# EasyEDA Pro project RCKid3.eprj, board RCKid (continued)
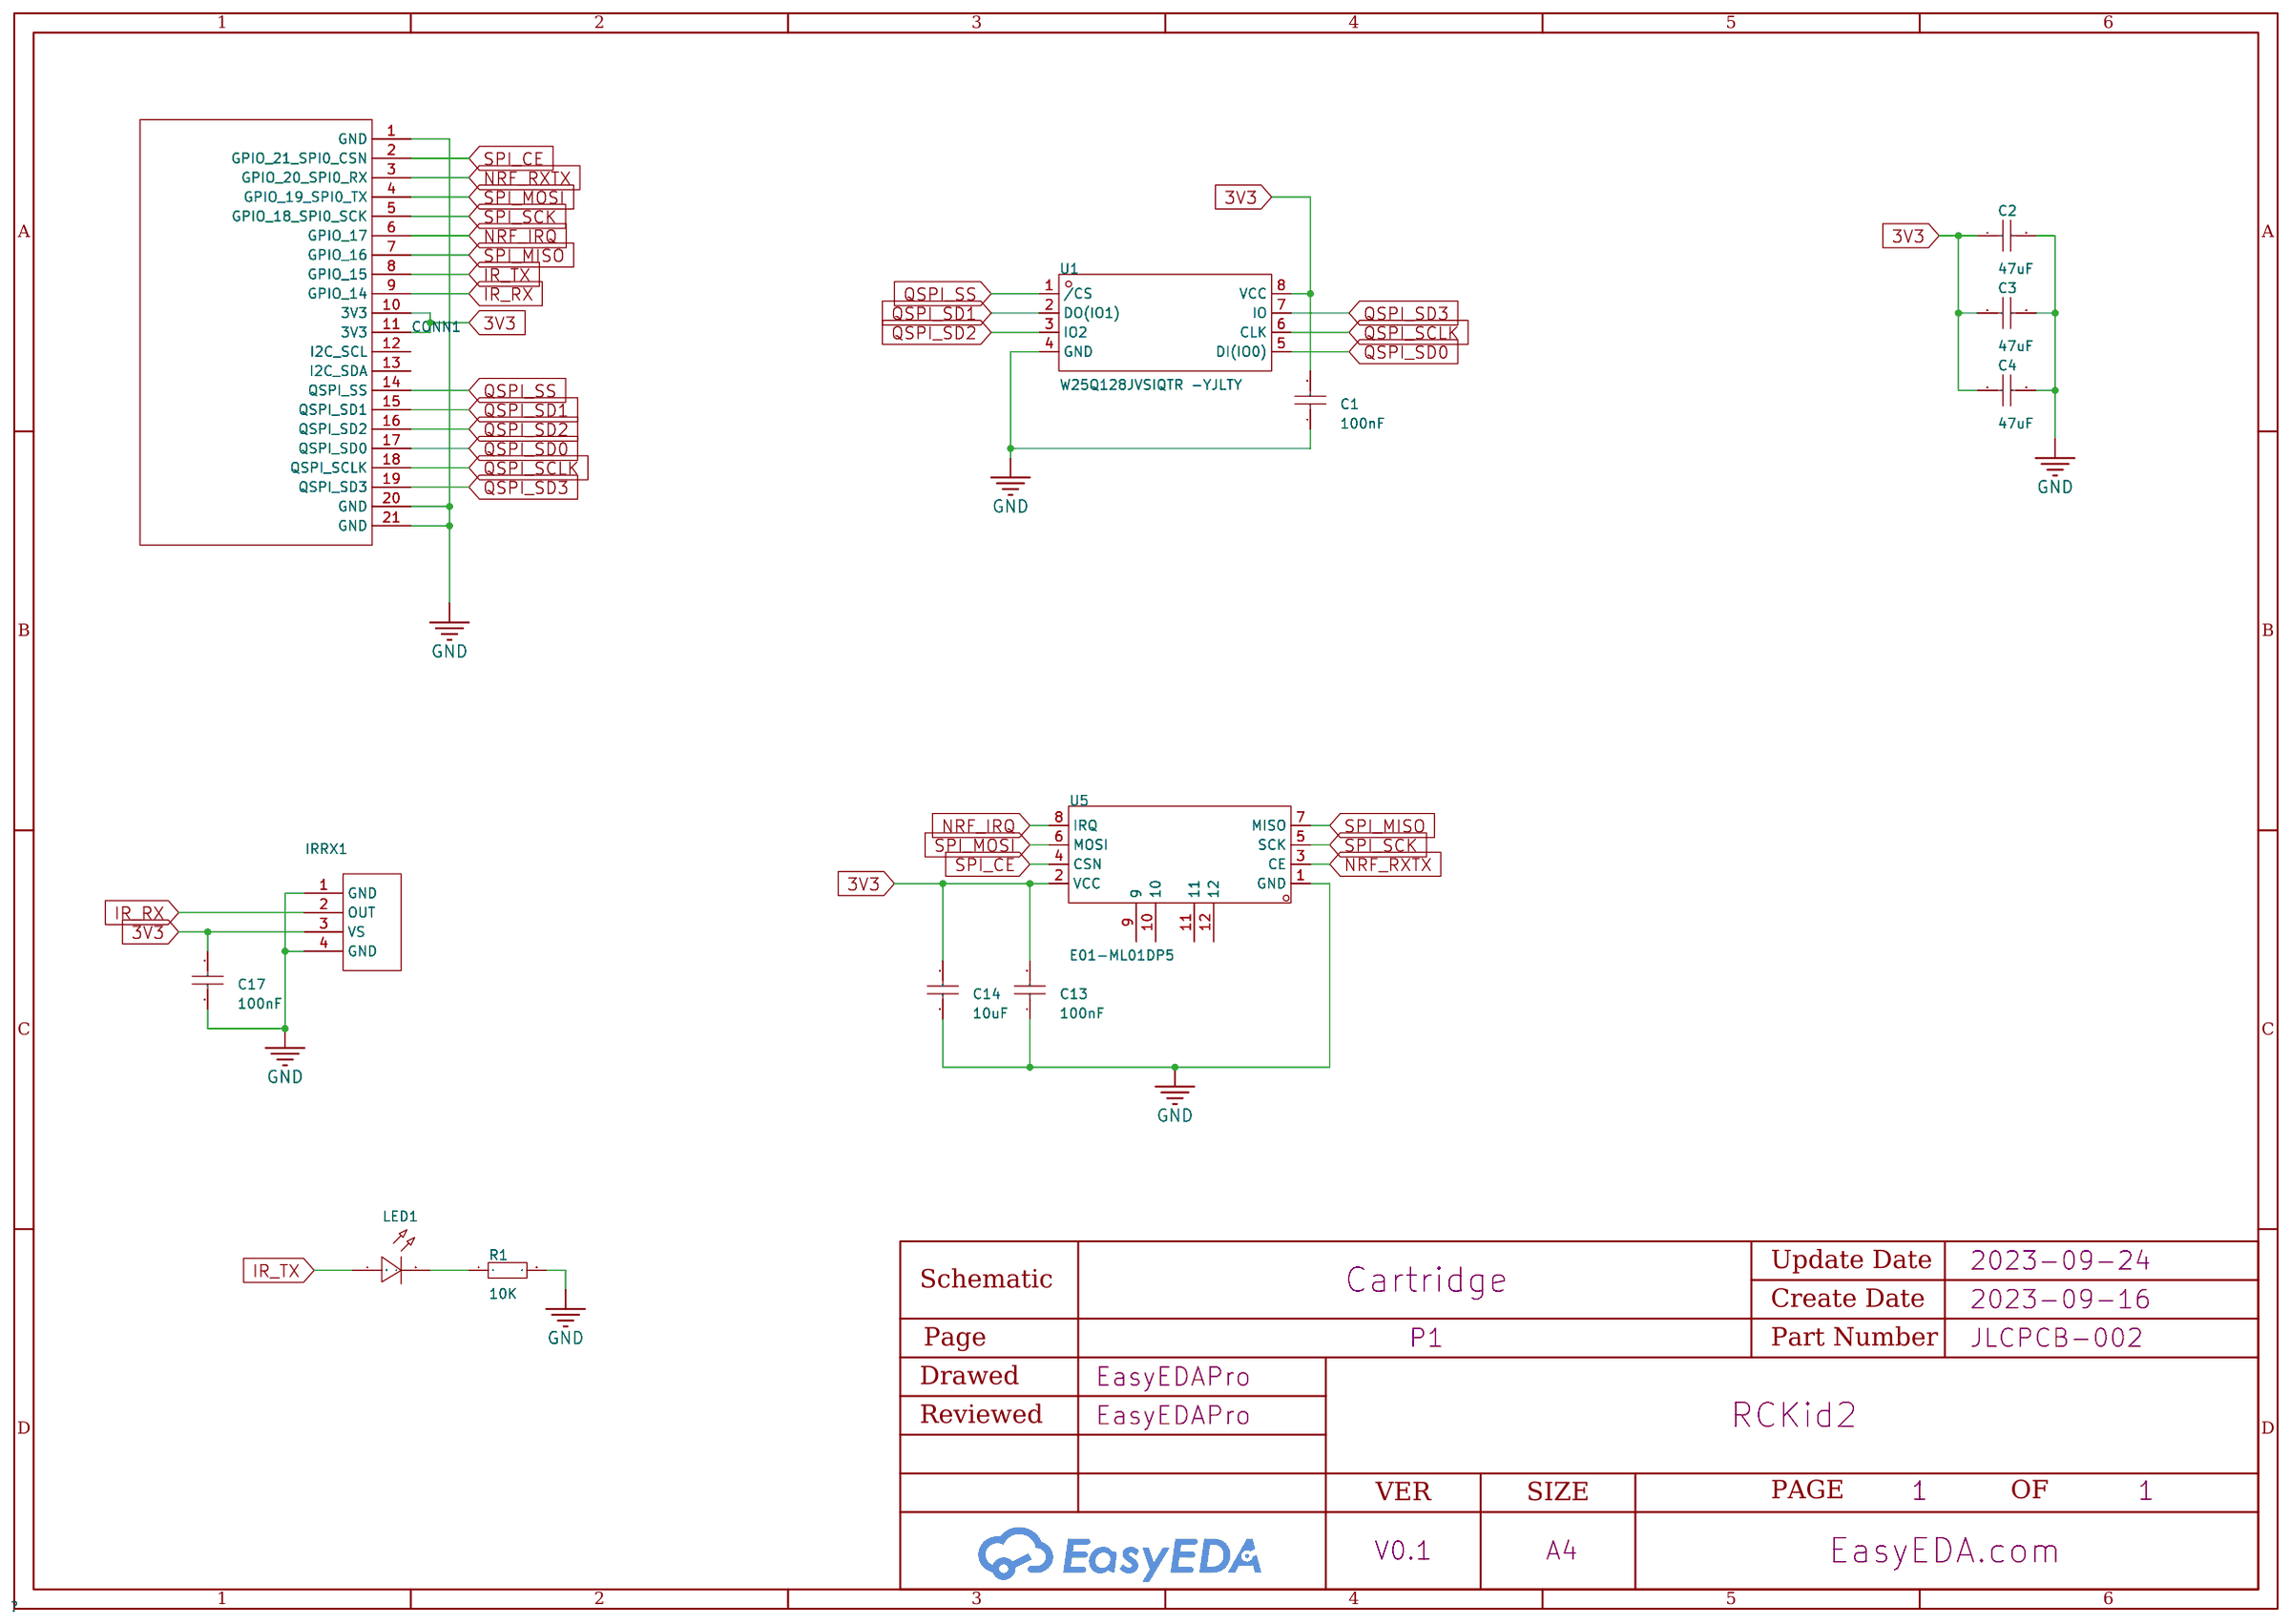
[diagram p0: NRF24L01P]
## Footprints (pads in the part's own frame, mm; a bottom-side part is the same pattern mirrored in y, then rotated) (continued)
SMT wire pad (2)
  rect 2.54x1.524 smd: 1(0,0)
  rrect 2.54x1.524 smd: 2(0,-2.54)
SOD-323_L1.8-W1.3-LS2.5-RD
  rect 1x0.75 smd: 1(-1.173,0) 2(1.173,0)
SOT-23-3_L2.9-W1.6-P1.90-LS2.8-BR
  rect 1.07x0.6 smd: 1(1.235,-0.95) 2(1.235,0.95) 3(-1.235,0)
SOT-23-6_L2.9-W1.6-P0.95-LS2.8-BR
  rect 1.1x0.6 smd: 1(1.35,-0.95) 2(1.35,0) 3(1.35,0.95) 4(-1.35,0.95) 5(-1.35,0) 6(-1.35,-0.95)
SOT-23_L2.9-W1.3-P1.90-LS2.4-BR
  rect 1x0.8 smd: 1(1.15,-0.95) 2(1.15,0.95) 3(-1.15,0)
TESTPOINT-SMD_BD1.5_P70-5000045R
  round 2 smd: 1(0,0)
TF-SMD_TF-01A
  rect 0.6x1.3 smd: 1(2.3,5.276) 2(1.2,5.276) 3(0.101,5.276) 4(-1,5.276) 5(-2.099,5.276) 6(-3.2,5.276) 7(-4.3,5.276) 8(-5.399,5.276) 9(-6.5,5.276)
  rect 1.2x1.4 smd: 10(-7.599,4.426) 13(7.08,4.426)
  rect 1.2x2 smd: 11(-7.76,-5.276) 12(7.76,-5.276)
UDFN-16_L3.3-W1.4-P0.40-BL-EP
  rect 0.2x0.4 smd: 1(-1.4,-0.6) 2(-1,-0.6) 3(-0.6,-0.6) 4(-0.2,-0.6) 5(0.2,-0.6) 6(0.6,-0.6) 7(1,-0.6) 8(1.4,-0.6) 9(1.4,0.6) 10(1,0.6) 11(0.6,0.6) 12(0.2,0.6) 13(-0.2,0.6) 14(-0.6,0.6) 15(-1,0.6) 16(-1.4,0.6)
  rect 2.8x0.4 smd: 17(0,0)
UQFN-10_L2.0-W1.5-P0.50-BL-EP
  rect 0.3x0.58 smd: 1(-0.748,-0.64) 4(0.752,-0.64) 6(0.752,0.64) 9(-0.748,0.64)
  rect 0.25x0.58 smd: 2(-0.248,-0.64) 3(0.252,-0.64) 7(0.252,0.64) 8(-0.248,0.64)
  rect 0.63x0.35 smd: 5(0.86,0) 10(-0.86,-0.002)
USB-C-SMD_TYPE-C-F02C-1BBWC1.6
  oval 1.2x2 hole 0.65x1.4: 13(5.62,1.425) 16(-5.62,1.425)
  oval 1.2x2.4 hole 0.65x1.8: 14(5.62,-2.575) 15(-5.62,-2.575)
  rect 0.3x1.1 smd: A5(-1.25,2.575) A6(-0.25,2.575) A7(0.25,2.575) A8(1.25,2.575) B5(1.75,2.575) B6(0.75,2.575) B7(-0.75,2.575) B8(-1.75,2.575)
  rect 0.6x1.1 smd: A9B4(2.4,2.575) A12B1(3.2,2.575) B9A4(-2.4,2.575) B12A1(-3.2,2.575)
VSON-6_L1.5-W1.5-P0.50-TL
  rect 0.6x0.25 smd: 1(-0.575,0.5) 2(-0.575,0) 3(-0.575,-0.5)
  rect 1x0.25 smd: 4(0.575,-0.5) 5(0.575,0) 6(0.575,0.5)
VSON-8_L3.0-W3.0-P0.65-TL-EP
  rect 0.85x0.34 smd: 1(-1.476,0.975) 2(-1.476,0.325) 3(-1.476,-0.325) 4(-1.476,-0.976) 5(1.476,-0.976) 6(1.476,-0.325) 7(1.476,0.325) 8(1.476,0.976)
  custom 1.52x3.42 smd: 9(0,-0.005)
WQFN-24_L4.0-W4.0-P0.50-TL-EP2.6
  rect 0.85x0.25 smd: 1(-2.025,1.25) 2(-2.025,0.75) 3(-2.025,0.25) 4(-2.025,-0.25) 5(-2.025,-0.75) 6(-2.025,-1.25) 13(2.025,-1.25) 14(2.025,-0.75) 15(2.025,-0.25) 16(2.025,0.25) 17(2.025,0.75) 18(2.025,1.25)
  rect 0.25x0.85 smd: 7(-1.25,-2.025) 8(-0.75,-2.025) 9(-0.25,-2.025) 10(0.25,-2.025) 11(0.75,-2.025) 12(1.25,-2.025) 19(1.25,2.025) 20(0.75,2.025) 21(0.25,2.025) 22(-0.25,2.025) 23(-0.75,2.025) 24(-1.25,2.025)
  rect 2.6x2.6 smd: 25(0.001,0)

## Nets
As in the schematic.

Pads without a net: 3V3 2; AMP 2; AUDIO 20 33; DISPLAY 1 2 3 4 8 25 26 27 28 34 35 36 37 38 39 40 41 42; HEADSET 5 6; L15 7 8 9 10; microSD 9 12 13; PWR 4 24; R88 2; RADIO 1 15 16 20 21; RP2350B 35 59; U26 4 10 11; U41 2 5; USB 13 14 15 16 A8 B8; VDD 2

## Via types
v1: diameter 0.5, hole 0.3, Top Layer to Bottom Layer, 660 vias

## Routing (per net, layer and track width the routed paths; a pad name or vN(x,y) marks a point on that pad's centre or on a via; arc(x,y) is an arc through that point)
3V3: length 31.2
  Top Layer w0.15: 28.9,28.39 28.9,29.59 29.2,29.59 v1(29.8,30.19) ; U26.12 27.9,39.69 28.9,38.69 U26.5 ; v1(31.7,41.79) 32.37,41.79 R124.2
  Top Layer w0.25: U40.8 22.79,52.94 ; C118.2 33.25,44.8 AVR.4 ; U26.5 30.85,38.69 C95.2 ; U41.1 29.85,53.84 29.2,53.19 28.74,53.19 C235.2 ; 29.55,41.99 29.55,41.44 29.05,40.94 U26.8
  Top Layer w0.3: U33.1 39.35,46.34 40.3,45.39 U33.5
  Top Layer w0.5: v1(33.5,43.69) 33.5,44.44 C118.2 ; v1(29.5,42.69) 29.5,42.05 29.55,41.99 ; R45.2 v1(26.4,45.39) ; C234.2 22.8,52.94 v1(22.8,52.19) ; C95.2 v1(30.9,37.79) ; R46.2 v1(26.4,44.09) ; v1(36.8,46.19) 37.6,46.19 37.75,46.34 U33.1 ; C235.2 v1(28.5,52.09)
  Bottom Layer w0.15: v1(29.8,30.19) 29.8,35.19 v1(29.4,35.59)
  vias: v1(29.4,36.39) v1(30.2,36.39) v1(30.2,35.59)
5V: length 20.1
  Top Layer w0.25: v1(46.05,45.14) 46,45.19 42.8,45.19 41.65,46.34 U33.6
  Top Layer w0.3: v1(41,23.49) 41,22.64 C144.2 41.05,22.5 LED12.2 ; LED8.2 56.1,51.94 C102.2 55.86,51.99 v1(55.1,51.99) ; LED11.2 23.11,26.24 C143.2 23.3,26.24 23.45,26.24 v1(24.4,25.29) ; v1(15.3,43.59) C104.2 14.45,43.39 LED10.2
  Top Layer w0.5: 36.3,22.59 v1(36.7,22.19) v1(35.9,22.19) 36.3,22.59 ; 36.3,22.59 C82.2 36.15,23.04 5V.1
  vias: v1(44.4,29.89)
5V_ON: length 30.8
  Top Layer w0.15: v1(33.2,24.89) 34.5,24.89 5V.3 ; v1(28.9,46.29) 28.9,45.82 R48.1 ; AVR.21 30.15,48.44 29.9,48.69 29.3,48.69 28.9,48.29 v1(28.9,48.09)
  Bottom Layer w0.15: v1(28.9,48.09) v1(28.9,46.29) 28.9,45.89 28.2,45.19 28.2,29.89 v1(33.2,24.89)
DVDD: length 10.3
  Top Layer w0.2: C115.2 v1(21.5,78.69) 21.3,78.69 21.2,78.79 RP2350B.10 ; RP2350B.51 7.3,78.79 v1(7,78.49) 6.6,78.09 C114.2 ; RP2350B.32 13.6,86.09 v1(13.4,86.29) 12.8,86.89 12.8,87.05
GND: length 81.5
  Top Layer w0.15: U40.3 26.45,53.44 v1(26.6,53.59) ; v1(1.9,19.39) 1.93,19.42 R113.2 ; v1(35.1,42.79) 34.53,42.79 34.5,42.82 ; 14.5,20.79 v1(14.5,20.09) 14.5,19.29
  Top Layer w0.2: 3.6,6.26 3.8,6.06 v1(3.8,5.39) ; 12.6,88.14 12.55,88.19 v1(12,88.19) ; v1(5,5.39) R57.2
  Top Layer w0.25: 65.4,24.59 v1(67,22.99) ; AUDIO.12 59.35,34.74 ; 59.35,34.74 59.85,34.24 AUDIO.28 ; 59.35,34.74 58.35,35.74 AUDIO.7 ; v1(17,91.09) 15.65,91.09 U39.4 ; v1(4,79.09) C110.1 ; v1(23.9,73.79) 23.85,73.79 23.74,73.9 23.74,73.95 C107.1 ; v1(12.1,90.39) 12.1,89.95 C154.2 ; C209.1 56.3,38.55 v1(56.3,39.29) ; v1(7.1,85.19) C111.1 ; v1(58.5,33.29) 57.85,32.64 AUDIO.17 ; 64.5,24.99 64.9,24.99 65.3,24.59 ; LED8.3 58.9,52.89 v1(58.9,53.79) ; 15.2,88.24 15.26,88.29 v1(16,88.29) ; v1(24.4,81.19) C112.1 ; v1(6.1,72.69) 6.1,73.55 ; RADIO.3 57.02,17.37 v1(56.8,17.59) ; C109.1 19.6,86.55 v1(19.6,87.29) ; C144.1 42.1,22.65 v1(42.1,23.49) ; v1(17.3,89.49) C153.2 ; C167.1 13.45,69.79 v1(14.2,69.79) ; v1(24.4,78.69) C115.1 ; v1(57.7,18.59) 58.02,18.91 58.02,19.5 ; AVR.25 32.75,47.94 AVR.3 ; v1(19.6,69.69) C108.1 ; 30.3,52.49 v1(30.3,51.89) ; v1(4,78.09) C114.1 ; U39.2 13.35,92.89 v1(12.2,92.89) ; LED12.3 42.1,19.59 v1(42.1,18.79)
  Top Layer w0.3: LED10.3 12.9,40.99 v1(12.9,40.09) ; v1(20.5,24.39) 20.5,25.29 LED11.3 ; C104.1 v1(12.1,43.59) ; C143.1 v1(23.2,24.39) ; 56,52.94 v1(56,53.79) ; v1(54.7,74.59) R55.2
  Top Layer w0.4: v1(66.7,35.39) 66.1,34.79 C204.2 ; v1(65.1,36.59) 64.14,36.59 C203.2 ; v1(8.7,9.59) 9.48,9.59 USB.B12A1 v1(9.5,10.59) ; C192.1 65.1,35.09 v1(65.4,35.39) ; v1(16.7,9.59) 16.67,9.56 USB.A12B1 v1(15.9,10.59) ; v1(58.9,28.09) 58.9,29.05 ; v1(54.9,25.29) R104.1
  Top Layer w0.5: v1(30.3,44.39) 29.5,44.39 ; 21.5,52.99 20.8,52.99 v1(20.79,53) ; v1(2.5,21.29) 2.5,20.59 ; v1(20.99,54) 21,53.99 21.7,53.99 ; v1(5.4,17.89) 5.4,18.79 ; v1(4.5,19.79) 5.1,20.39 5.2,20.39 ; 39.8,51.09 40.4,51.09 v1(40.9,51.59) ; v1(30.9,40.79) 30.9,39.89 ; 28.5,54.09 28.5,54.39 v1(29,54.89) ; 39.9,52.69 40.88,52.69 v1(40.89,52.7) ; 57.5,21.09 v1(57.5,21.79) 57.5,22.49 ; v1(47,8.49) 45.8,8.49 ; v1(26.4,50.59) 25.6,50.59 ; v1(37.3,45.39) 38.3,45.39 ; v1(8.6,27.79) 8.6,26.99 ; 8.6,26.99 v1(7.9,26.99) ; 8.6,26.99 8.6,26.79 ; v1(35.1,36.39) 35.8,36.39 ; v1(30.6,42.69) 30.6,42.09 ; 10.5,26.99 10.5,26.89 ; 10.5,26.99 v1(10.5,27.79) ; 10.5,26.99 v1(11.3,26.99) ; 10.5,26.99 10.4,26.99 ; v1(34.6,34.79) 34.6,35.49 ; v1(51.5,75.59) 51.5,74.78 Q6.2 51.58,74.79 v1(52.7,74.79) ; C118.1 34.6,44.45 v1(34.6,43.69) ; v1(34.9,37.39) 34.9,38.39 ; v1(8.1,16.99) 8.1,17.69 ; C81.1 v1(29.2,24.69) ; C132.1 50,89.09 v1(49,89.09)
  vias: v1(-31.5,49.69) v1(-31.5,48.59) v1(-31.4,44.99) v1(-31.3,43.29) v1(-31.1,46.79) v1(-30.55,54.38) v1(-30.4,62.49) v1(-29.8,42.39) v1(-29.6,45.59) v1(-29.5,77.89) v1(-29.5,75.89) v1(-29.5,73.89) v1(-29.2,48.29) v1(-29.1,50.19) v1(-29,43.79) v1(-28.9,60.99) v1(-28.7,45.99) v1(-28.6,39.99) v1(-28,74.59) v1(-28,61.89) v1(-27.7,48.49) v1(-27.2,44.69) v1(-27,62.59) v1(-26.8,49.89) v1(-26.5,46.59) v1(-26.3,58.79) v1(-26.3,43.49) v1(-26.2,48.29) v1(-26,73.49) v1(-26,31.99) v1(-25.2,44.49) v1(-24.6,42.79) v1(-24.4,58.99) v1(-24.4,56.19) v1(-24.4,47.99) v1(-24.4,36.19) v1(-24.4,33.79) v1(-24.2,74.59) v1(-24.2,54.09) v1(-24,45.79) v1(-23.8,49.69) v1(-23.7,32.59) v1(-23.6,40.19) v1(-23.2,47.59) v1(-22.2,42.89) v1(-22.2,39.29) v1(-22.1,37.49) v1(-21.9,77.49) v1(-21.9,71.99) v1(-21.9,69.99) v1(-21.9,67.99) v1(-21.9,65.99) v1(-21.9,64.19) v1(-21.8,47.29) v1(-21.7,74.59) v1(-21.6,44.99) v1(-21.6,41.59) v1(-21.1,34.69) v1(-20.5,44.29) v1(-20.3,83.89) v1(-20.3,47.89) v1(-19.9,65.99) v1(-19.9,64.19) v1(-19.9,36.99) v1(-19.7,45.69) v1(-19.5,71.99) v1(-19.1,74.59) v1(-19,77.59) v1(-18.2,38.89) v1(-17.9,78.39) v1(-17.8,76.59) v1(-17.7,51.59) v1(-17.5,41.79) v1(-17.2,38.89) v1(-17.1,46.19) v1(-17,47.89) v1(-16.9,64.19) v1(-16.7,77.29) v1(-16.6,74.59) v1(-16.2,58.19) v1(-16,61.09) v1(-16,46.19) v1(-15.8,43.59) v1(-15.6,52.09) v1(-15.3,77.29) v1(-15.3,53.69) v1(-15.3,49.59) v1(-14.8,47.79) v1(-14.3,74.59) v1(-14.3,40.69) v1(-14.1,51.39) v1(-14.1,46.49) v1(-14,61.09) v1(-13.9,44.09) v1(-13.8,77.59) v1(-13.4,57.49) v1(-13.3,73.59) v1(-13.3,52.49) v1(-13.1,40.09) v1(-12.8,55.69) v1(-12.8,43.19) v1(-12.7,76.99) v1(-12.7,45.59) v1(-12.3,64.19) v1(-12.3,49.99) v1(-12.1,74.99) v1(-11.9,59.99) v1(-11.8,57.09) v1(-11.8,41.89) v1(-11.6,76.19) v1(-11.6,43.89) v1(-11.5,47.09) v1(-11.4,53.49) v1(-11.4,49.19) v1(-11.1,40.59) v1(-10.8,42.69) v1(-10.6,81.79) v1(-10.5,40.19) v1(-10.4,43.79) v1(-10.3,52.59) v1(-10,50.59) v1(-9.9,94.89) v1(-9.8,47.59) v1(-9.6,88.19) v1(-9.6,83.79) v1(-9.4,45.29) v1(-9.3,46.49) v1(-9.1,38.69) v1(-8.9,41.59) v1(-8.8,48.99) v1(-8.7,88.09) v1(-8.6,44.39) v1(-8.5,51.49) v1(-8.1,96.79) v1(-8.1,47.29) v1(-7.5,86.39) v1(-7,90.79) v1(-7,40.49) v1(-6.4,51.19) v1(-6.2,45.79) v1(-5.3,46.29) v1(-4.8,93.39) v1(0.9,107.89) v1(1,103.19) v1(2.2,103.99) v1(3,103.69) v1(4.2,109.89) v1(4.2,103.99) v1(5.3,103.89) v1(6.2,103.99) v1(6.9,69.79) v1(7.5,107.09) v1(8.2,103.99) v1(9.8,22.39) v1(9.8,20.79) v1(9.8,13.59) v1(10.2,103.99) v1(10.4,109.99) v1(11.5,20.79) v1(11.6,22.39) v1(12.2,103.99) v1(12.8,80.39) v1(12.8,78.99) v1(12.8,77.59) v1(13.4,109.99) v1(14.1,53.49) v1(14.2,103.99) v1(14.2,80.39) v1(14.2,78.99) v1(14.2,77.59) v1(14.5,15.39) v1(15.5,24.89) v1(15.6,80.39) v1(15.6,78.99) v1(15.6,77.59) v1(16.2,103.99) v1(16.2,49.99) v1(18.1,109.99) v1(18.2,103.99) v1(20.2,103.99) v1(20.4,107.89) v1(20.4,105.49) v1(22.1,109.99) v1(26.2,109.99) v1(26.2,103.59) v1(27.2,6.49) v1(27.7,2.49) v1(28.6,-2.01) v1(28.8,-0.01) v1(29.2,31.89) v1(29.8,6.99) v1(30.1,-4.31) v1(30.3,31.89) v1(31,4.79) v1(31.2,1.09) v1(31.3,8.29) v1(31.5,109.99) v1(31.9,8.19) v1(32.2,48.99) v1(32.2,47.39) v1(32.8,8.49) v1(33.5,1.49) v1(33.6,23.99) v1(33.7,9.19) v1(33.8,48.99) v1(33.8,47.39) v1(34.4,103.39) v1(34.5,8.89) v1(34.5,1.79) v1(34.6,6.29) v1(34.8,10.19) v1(34.9,109.99) v1(35.2,-0.61) v1(35.7,10.69) v1(35.8,6.69) v1(35.9,10.79) v1(35.9,8.09) v1(36,7.89) v1(36.1,9.49) v1(36.1,4.69) v1(36.2,25.69) v1(36.8,9.49) v1(37.1,10.89) v1(37.4,5.89) v1(37.5,9.29) v1(38.4,109.99) v1(38.4,11.49) v1(38.9,103.59) v1(39,7.99) v1(39.1,92.19) v1(39.7,10.29) v1(39.9,12.79) v1(40,11.79) v1(40.7,39.99) v1(40.7,39.19) v1(40.9,13.49) v1(41,103.19) v1(41,9.89) v1(41.2,11.59) v1(41.4,109.99) v1(41.6,8.79) v1(41.9,12.79) v1(42.1,13.79) v1(42.1,6.59) v1(42.4,103.59) v1(42.5,10.69) v1(42.5,9.89) v1(42.6,11.79) v1(43,42.59) v1(43.5,6.29) v1(43.7,103.49) v1(44.4,109.99) v1(44.4,30.89) v1(45.2,103.09) v1(45.7,103.69) v1(46.6,103.19) v1(47.3,109.99) v1(47.5,103.19) v1(48.7,103.39) v1(48.8,30.79) v1(49.2,109.99) v1(50.2,103.99) v1(50.2,99.99) v1(50.2,95.99) v1(51.2,109.99) v1(51.4,106.49) v1(54.2,103.99) v1(54.2,95.99) v1(54.2,91.99) v1(54.2,87.99) v1(55,23.09) v1(55.3,107.29) v1(55.8,103.69) v1(56,25.69) v1(56.8,18.59) v1(57.2,109.99) v1(57.7,17.59) v1(58.2,103.99) v1(58.2,99.99) v1(58.2,95.99) v1(58.2,91.99) v1(58.2,87.99) v1(58.5,35.69) v1(58.9,25.69) v1(59.4,15.89) v1(59.8,25.39) v1(60.5,103.89) v1(60.8,105.19) v1(60.8,35.79) v1(60.85,33.24) v1(61.5,109.99) v1(62.2,103.99) v1(62.2,95.99) v1(62.2,91.99) v1(62.2,87.99) v1(63.2,5.09) v1(63.6,106.19) v1(63.6,103.99) v1(64.6,109.79) v1(65.1,65.09) v1(66.2,103.99) v1(66.2,99.99) v1(66.2,97.99) v1(66.2,95.99) v1(66.2,93.99) v1(66.2,91.99) v1(66.2,89.99) v1(66.2,87.99) v1(66.2,85.99) v1(66.2,83.99) v1(66.2,81.99) v1(66.2,79.99) v1(66.2,77.99) v1(66.2,75.69) v1(66.2,72.99) v1(66.2,70.09) v1(66.7,65.09) v1(66.7,31.29) v1(67.5,107.89) v1(67.5,105.29) v1(67.6,67.79) v1(67.6,26.39) v1(69.8,42.49) v1(76.3,73.69) v1(77.1,75.09) v1(78.7,73.69) v1(79.2,92.59) v1(79.2,88.89) v1(79.2,84.79) v1(80.2,82.29) v1(80.7,83.99) v1(81.2,90.49) v1(81.3,73.69) v1(81.5,85.39) v1(81.6,72.29) v1(82.2,86.79) v1(82.5,78.29) v1(82.6,93.19) v1(82.62,72.24) v1(82.7,82.49) v1(82.7,75.79) v1(82.9,72.89) v1(83,89.39) v1(83.2,80.39) v1(83.6,76.29) v1(83.6,71.39) v1(83.8,84.59) v1(83.9,73.69) v1(84,90.49) v1(84.9,88.09) v1(85.5,86.19) v1(85.5,80.49) v1(85.7,91.39) v1(85.7,75.09) v1(85.9,79.89) v1(85.9,77.19) v1(86.1,93.69) v1(86.4,82.89) v1(86.4,74.29) v1(86.6,89.69) v1(86.8,84.49) v1(87.5,78.19) v1(87.6,79.79) v1(87.7,73.69) v1(87.8,87.19) v1(88.1,75.39) v1(88.2,85.29) v1(88.7,93.79) v1(88.8,80.99) v1(88.8,72.09) v1(88.9,89.99) v1(89.3,83.59) v1(89.4,77.19) v1(90.2,80.29) v1(90.3,73.69) v1(90.6,85.69) v1(90.8,88.29) v1(91.3,91.69) v1(91.3,77.89) v1(91.5,74.59) v1(91.6,82.79) v1(93.2,72.89) v1(95,73.69)
VBATT: length 4
  Bottom Layer w0.15: v1(17,16.49) R126.2
  Bottom Layer w0.5: v1(17,16.49) v1(17,14.49)
VCC: length 10.7
  Top Layer w0.15: 26.7,32.49 26.7,31.39
  Top Layer w0.5: v1(32.8,23.99) 5V.5 30.8,23.99 C81.2
  Top Layer w0.7: C220.2 C219.2 6.45,25.39 L17.2 6.1,27.96 AAA_PWR.2
  vias: v1(11.5,25.59) v1(11.5,24.79) v1(12.3,25.59) v1(12.3,24.79) v1(13.1,25.59) v1(13.1,24.79) v1(23.4,32.99) v1(23.4,32.29) v1(24.1,32.99) v1(24.1,32.29) v1(33.4,39.89) v1(33.4,39.19) v1(34.1,39.89) v1(34.1,39.19)
VDD_EN: length 28.1
  Top Layer w0.15: v1(34.8,45.29) 33.9,45.29 33.75,45.44 AVR.5 ; v1(30.6,50.49) 27.6,50.49 v1(26.4,51.69) 25.84,52.25 U40.1 ; 36.7,38.19 36.2,38.19 36,38.39 v1(36,38.59) ; v1(26,54.99) 25.7,54.99 25.2,54.49 U40.5
  Bottom Layer w0.15: v1(26.4,51.69) 26,52.09 v1(26,54.99) ; v1(30.6,50.49) 31.5,50.49 34.8,47.19 v1(34.8,45.29) 34.8,44.29 36,43.09 v1(36,38.59)
ACCEL_INT: length 9.4
  Top Layer w0.15: v1(29.6,48.09) 29.9,48.09 30.05,47.94 AVR.22 ; v1(28.8,41.69) 28.55,41.44 U26.9
  Bottom Layer w0.15: v1(28.8,41.69) 28.8,44.79 29.6,45.59 v1(29.6,48.09)
AUDIO_INT: length 67.5
  Top Layer w0.15: RP2350B.2 19.5,75.59 20,75.09 20,74.79 23.1,71.69 23.1,69.29 30,62.39 30,58.59 31.5,57.09 34.3,57.09 34.7,56.69 47.7,56.69 50.9,53.49 50.9,41.99 52.9,39.99 52.9,36.29 53.95,35.24 AUDIO.11
AUDIO_MICBIAS: length 7
  Top Layer w0.15: R123.2 v1(54.9,30.89) R103.2 ; AUDIO.19 58.85,31.44 v1(59.1,31.19)
  Bottom Layer w0.15: v1(54.9,30.89) 58.8,30.89 v1(59.1,31.19)
AUDIO_RESET: length 74.8
  Top Layer w0.15: AUDIO.31 62.55,35.74 62.8,35.99 62.8,40.59 60.5,42.89 54.5,42.89 53.9,43.49 53.9,55.09 49.3,59.69 36.2,59.69 35.61,60.29 35.61,61.89 33.8,63.69 33.15,63.69 26.1,70.74 26.1,74.79 23.5,77.39 21.4,77.39 20.8,77.99 RP2350B.8
AVR_INT: length 33.7
  Top Layer w0.15: v1(21.8,71.19) 18.91,74.08 RP2350B.80 ; v1(26.4,49.19) 28.1,49.19 28.2,49.29 30,49.29 30.35,48.94 AVR.20
  Bottom Layer w0.15: v1(26.4,49.19) 23.6,51.99 23.6,56.24 22.7,57.14 22.7,70.29 v1(21.8,71.19)
AVR_TX: length 36.5
  Top Layer w0.15: AVR.24 24.45,46.94 14.3,57.09 v1(12.8,57.09)
  Bottom Layer w0.15: DEBUG.1 8.02,57.09 v1(12.8,57.09)
BTN_1: length 45
  Top Layer w0.15: D17.2 D9.2 43.23,51.19 41.8,51.19 v1(40.5,49.89) 40.05,49.44 35.02,49.44
  Top Layer w0.2: v1(35.9,19.59) 35,18.69 D5.2
  Bottom Layer w0.15: v1(35.9,19.59) 37.9,21.59 37.9,47.29 40.6,49.99
BTN_2: length 46.4
  Top Layer w0.15: D10.2 D14.2 43.28,47.94 35.02,47.94
  Top Layer w0.2: D6.2 33.3,18.79 33.5,18.99 v1(34.2,18.99)
  Bottom Layer w0.15: v1(34.2,18.99) 37.6,18.99 39.1,20.49 39.1,45.49 41.6,47.99 v1(42.3,47.99)
BTN_3: length 48.2
  Top Layer w0.15: D11.2 36.7,17.89 35.8,16.99 32.5,16.99 31.6,17.89 D7.2 ; 35.02,48.44 41.15,48.44 v1(41.9,49.19) 42.3,49.59 D15.2
  Top Layer w0.2: 36.7,18.22 38,19.52 v1(38,20.49)
  Bottom Layer w0.15: v1(38,20.49) 38.5,20.99 38.5,45.79 v1(41.9,49.19)
BTN_4: length 38.8
  Top Layer w0.15: AVR.6 34.83,46.17 v1(36.9,44.09)
  Top Layer w0.2: D12.2 28.2,18.89 28.5,19.19 v1(29,19.19) 29.6,19.19 29.9,18.89 D8.2
  Bottom Layer w0.15: v1(29,19.19) 29.7,19.89 35.3,19.89 37.3,21.89 37.3,43.69 v1(36.9,44.09)
BTN_ABXY: length 102.7
  Top Layer w0.15: v1(40.5,33.49) A1.2 A1.4 ; 44.1,18.09 B2.2 39.7,17.99 v1(39,18.69) 36.7,16.39 25.75,16.39 24.2,17.94 B3.4 ; 35.02,47.44 41.95,47.44 v1(42.3,47.09) ; v1(55.2,45.59) B1.2 B1.4
  Top Layer w0.2: B3.4 B3.2 ; B2.4 B2.2
  Bottom Layer w0.15: v1(55.2,45.59) 53.7,47.09 v1(42.3,47.09) 41.6,47.09 39.7,45.19 39.7,34.29 v1(40.5,33.49) 39.7,32.69 39.7,19.39 v1(39,18.69)
BTN_CTRL: length 62.1
  Top Layer w0.15: v1(44.5,50.39) 42.2,50.39 40.75,48.94 35.02,48.94 ; v1(63.7,38.89) v1(63.7,42.99) 63.7,54.89 v1(66,57.19)